# EasyEDA Pro project CV键盘三键键盘四键键盘九键键盘有线小键盘.eprj, board 1x3+6_rgb
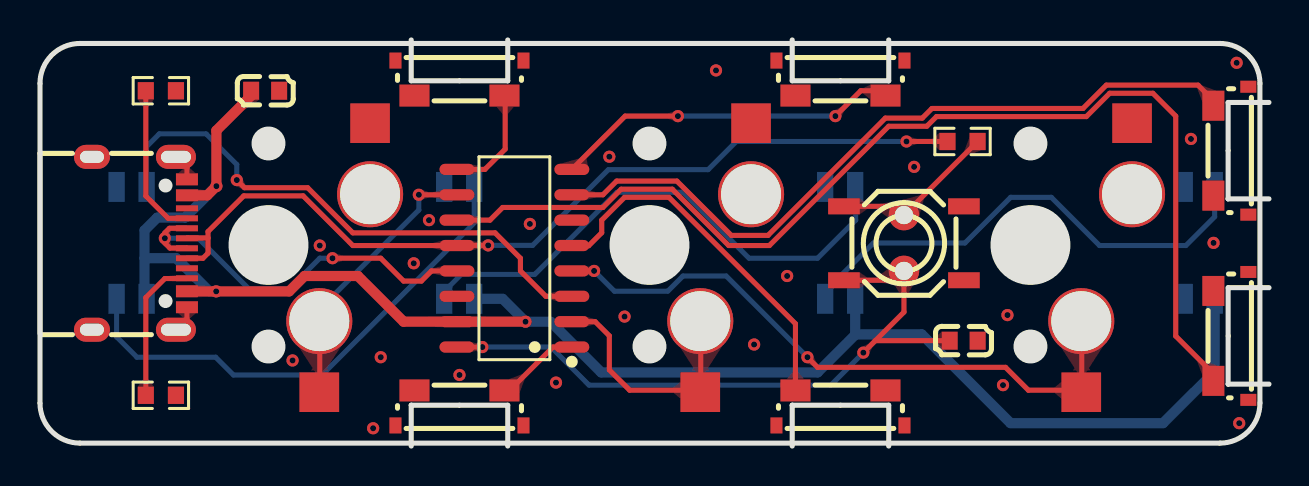
[diagram p13: board, top side]
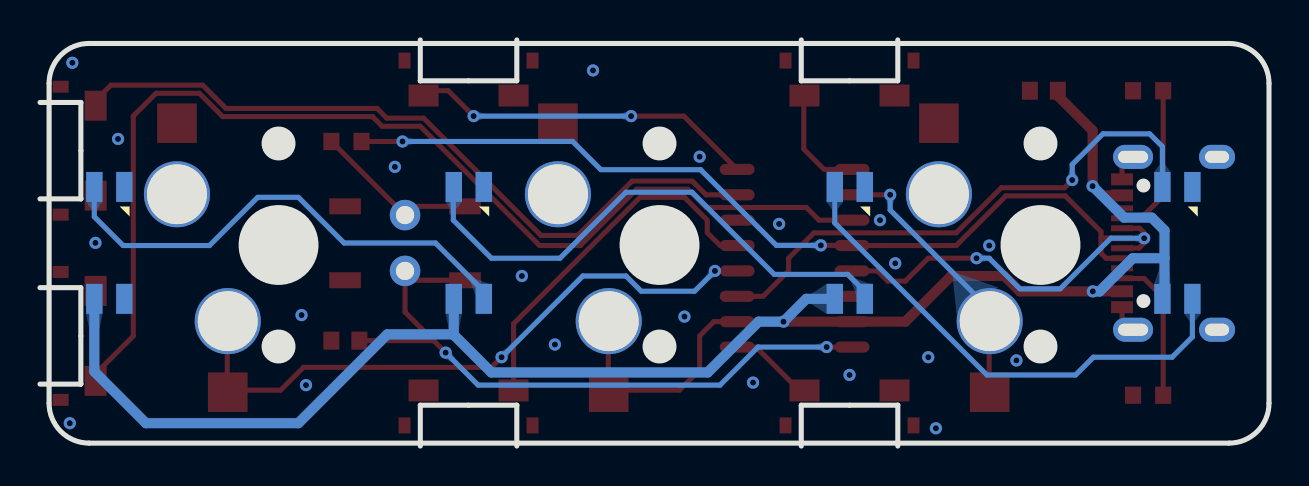
[diagram p14: board, bottom side, seen from below]

Outline 61.45 x 20.32 mm; copper layers: Top Layer, Bottom Layer. Coordinates in mm from the lower left corner of the outline.
Outline path: 0,18.15 arc(0.59,19.56) 2,20.15 59,20.15 arc(60.41,19.56) 61,18.15 61,2.15 arc(60.41,0.73) 59,0.15 2,0.15 arc(0.59,0.73) 0,2.15 0,18.15
Stack: Top Layer 0.035mm / Dielectric1 1.51mm FR4 er 4.5 / Bottom Layer 0.035mm

## Design rules (mm)
spacing Default (default): track to track 0.152, other pairs 0 to 0.152
track width Default (default): min 0.254, default 0.305, max 25.4
differential pair differentialPair (default): width min 0.127, default 0.254, max 2.54; gap min 0.152, default 0.152
via Default (default): diameter min 0.61, default 0.61, max 100.025; hole min 0.305, default 0.305, max 59.995
net GND uses gge1415

## Placement (name value [footprint] x y rotation side)
C1  100nF  [C0603]  46.19 5.27 0 top
C2  100nF  [C0603]  11.26 17.78 180 top
KEY1  -  [热插拔轴座]  49.55 10.16 270 bottom
KEY2  -  [热插拔轴座]  30.5 10.16 270 bottom
KEY3  -  [热插拔轴座]  11.45 10.16 270 bottom
NOREF  -  [Pad_e99]  43.2 11.56 90 top
NOREF#2  -  [Pad_e101]  43.2 8.76 90 top
R1  10K  [R0603]  46.13 15.24 0 top
R2  5.1K  [R0603]  6.05 17.78 0 top
R3  5.1K  [R0603]  6.05 2.54 0 top
SW1  TSA356G00-250  [SW-SMD_TSA356G00-250]  59.55 14.78 90 top
SW1#2  TS-1076S-A1B2  [SW-SMD_4P-L5.2-W5.2-P3.70-LS6.4]  43.2 10.15 180 top
SW2  TSA356G00-250  [SW-SMD_TSA356G00-250]  59.55 5.51 90 top
SW3  TSA356G00-250  [SW-SMD_TSA356G00-250]  40.03 18.41 180 top
SW4  TSA356G00-250  [SW-SMD_TSA356G00-250]  40.03 1.91 0 top
SW5  TSA356G00-250  [SW-SMD_TSA356G00-250]  20.97 18.41 180 top
SW6  TSA356G00-250  [SW-SMD_TSA356G00-250]  20.97 1.91 0 top
U1  CH552G  [SOP-16_L10.0-W3.9-P1.27-LS6.0-BL]  23.72 9.4 90 top
U2  TypeC-16PIN  [USB-C-SMD_TYPE-C-6PIN-2MD-073]  4.97 10.15 270 top
U3  -  [ws2812反贴灯上装不挖槽反捏]  4.59 10.17 90 top
U4  -  [ws2812反贴灯上装不挖槽反捏]  20.97 10.17 90 top
U5  -  [ws2812反贴灯上装不挖槽反捏]  40.03 10.17 90 top
U6  -  [ws2812反贴灯上装不挖槽反捏]  58 10.17 90 top

## Footprints (pads in the part's own frame, mm; a bottom-side part is the same pattern mirrored in y, then rotated)
C0603
  rect 0.8x0.9 smd: 1(-0.7,0) 2(0.7,0)
Pad_e99
  round 1.524 hole 0.914: 1(0,0)
Pad_e101
  round 1.524 hole 0.914: 2(0,0)
R0603
  rect 0.806x0.864 smd: 1(-0.753,0) 2(0.753,0)
SOP-16_L10.0-W3.9-P1.27-LS6.0-BL
  oval 0.56x1.745 smd: 1(-4.445,-2.873) 2(-3.175,-2.873) 3(-1.905,-2.873) 4(-0.635,-2.873) 5(0.635,-2.873) 6(1.905,-2.873) 7(3.175,-2.873) 8(4.445,-2.873) 9(4.445,2.873) 10(3.175,2.873) 11(1.905,2.873) 12(0.635,2.873) 13(-0.635,2.873) 14(-1.905,2.873) 15(-3.175,2.873) 16(-4.445,2.873)
SW-SMD_4P-L5.2-W5.2-P3.70-LS6.4
  rect 1.58x0.8 smd: 1(-2.999,1.849) 2(2.999,1.849) 3(-2.999,-1.849) 4(2.999,-1.849)
SW-SMD_TSA356G00-250
  rect 1.501x1.1 smd: 1(-2.251,0.876) 2(2.251,0.876)
  rect 0.6x0.8 smd: 3(-3.2,-0.874) 4(3.2,-0.874)
USB-C-SMD_TYPE-C-6PIN-2MD-073
  rect 0.6x1.1 smd: 1(-3.2,2.375) 2(-2.4,2.375) 11(2.4,2.375) 12(3.2,2.375)
  rect 0.3x1.1 smd: 3(-1.75,2.375) 4(-1.25,2.375) 5(-0.75,2.375) 6(-0.25,2.375) 7(0.25,2.375) 8(0.75,2.375) 9(1.25,2.375) 10(1.75,2.375)
  oval 1.2x2 hole 0.6x1.5: 13(-4.325,1.825) 14(4.325,1.825)
  oval 1.2x1.8 hole 0.6x1.2: 13(-4.325,-2.375) 14(4.325,-2.375)
ws2812反贴灯上装不挖槽反捏
  rect 1.5x0.82 smd far side: 1(2.794,0.762) 2(2.794,-0.738) 3(-2.806,-0.738) 4(-2.806,0.762)
热插拔轴座
  rect 1.981x1.981 smd far side: 1(-5.995,-5.056) 2(7.466,-2.515)
  round 3.304 hole 3: 1(-2.439,-5.056) 2(3.91,-2.515)

## Nets
As in the schematic, except:
3.3V: C1.1 NOREF#2.2 SW1#2.2 U1.16
RST: NOREF.1 R1.2 SW1#2.4

Pads without a net: SW1#2 1 3; U1 6; U2 3 9; U6 4

## Via types
v1: diameter 0.61, hole 0.305, Top Layer to Bottom Layer, 36 vias

## Routing (per net, layer and track width the routed paths; a pad name or vN(x,y) marks a point on that pad's centre or on a via; arc(x,y) is an arc through that point)
3.3V: length 34.1
  Top Layer w0.254: 41.77,5.27 v1(41.17,4.67) ; 41.77,5.27 43.2,6.7 43.2,8.48 ; 41.77,5.27 C1.1 ; 43.02,8.48 42.92,8.48 42.73,8.3 SW1#2.2 ; 43.02,8.48 43.2,8.48 ; 43.02,8.48 43.02,8.36 ; 43.2,8.48 NOREF#2.2 ; U1.16 v1(22.12,4.95) ; 43.02,8.36 43.02,8.35 42.9,8.23 42.89,8.36 43.02,8.36
  Bottom Layer w0.254: v1(41.17,4.67) 39.54,3.05 27.45,3.05 25.55,4.95 v1(22.12,4.95)
GND: length 2.7
  Top Layer w0.254: U2.12 7.35,6.37 U2.14 ; U2.13 7.35,13.92 U2.1
  vias: v1(12.63,4.28) v1(13.99,10.03) v1(16.66,0.89) v1(17.04,4.44) v1(18.69,9.14) v1(19.45,11.3) v1(20.97,3.56) v1(24.5,11.11) v1(25.8,3.17) v1(28.47,14.48) v1(29.23,6.48) v1(33.8,18.8) v1(35.71,5.08) v1(37.36,8.51) v1(43.71,13.97) v1(48.15,3.05) v1(48.38,6.55) v1(57.55,15.37) v1(58.68,10.17) v1(59.84,19.18) v1(59.96,1.14)
VCC: length 85.3
  Top Layer w0.508: 7.35,7.75 7.36,7.74 v1(8.81,7.74) 12.46,7.74 13.23,8.51 15.9,8.51 18.18,6.22 U1.15 v1(24.28,6.22) ; U2.2 8.36,12.55 v1(8.82,13) 8.82,15.79 10.56,17.53 C2.2
  Bottom Layer w0.508: 40.76,5.56 38.88,3.68 28.06,3.68 25.52,6.22 v1(24.28,6.22) 23.13,7.37 U4.3 ; 40.76,5.56 40.79,5.59 44.09,5.59 48.53,1.14 56.15,1.14 58.74,3.73 58.74,7.37 ; 40.76,5.56 U5.3 ; U3.3 5.23,7.47 5.23,9.4 ; 5.23,9.4 6.81,9.4 8.47,7.74 v1(8.81,7.74) ; 5.23,9.4 5.23,10.8 5.86,11.43 7.25,11.43 v1(8.82,13)
DM: length 19.9
  Top Layer w0.254: U2.7 7.34,9.91 6.5,9.91 6.24,10.16 6.24,10.67 6.47,10.9 U2.5 ; U1.13 19.58,8.76 19.07,8.25 18.18,8.25 17.04,9.4 v1(14.62,9.4)
  Bottom Layer w0.254: v1(6.24,10.4) 7.91,10.4 10.44,7.87 12.46,7.87 13.99,9.4 v1(14.62,9.4)
DP: length 44.2
  Top Layer w0.254: v1(22.41,10.04) 20.86,10.04 U1.12 15.64,10.03 13.15,12.52 10.19,12.52 8.4,10.73 8.4,10.41 ; 8.4,10.41 8.4,9.65 8.15,9.4 U2.8 ; 8.4,10.41 7.37,10.41 U2.6 ; v1(43.33,15.24) R1.1
  Bottom Layer w0.254: v1(43.33,15.24) 34.82,15.24 33.41,13.83 28.42,13.83 24.63,10.04 v1(22.41,10.04)
K1: length 32.2
  Top Layer w0.254: 52.09,2.65 52.09,2.78 ; 52.09,2.78 52.09,6.21 ; 52.09,2.78 52.08,2.79 49.42,2.79 48.28,3.94 38.88,3.94 v1(38.37,4.44) ; v1(27.71,8.76) U1.4
  Bottom Layer w0.254: v1(27.71,8.76) 28.72,7.75 31.39,7.75 32.15,8.51 34.31,8.51 v1(38.37,4.44)
K2: length 12.3
  Top Layer w0.254: U1.2 27.76,6.22 28.47,5.52 28.47,3.81 29.48,2.79 33.04,2.79 33.04,6.22
K3: length 13.8
  Top Layer w0.254: v1(18.94,12.57) U1.10 ; 13.99,2.78 13.99,6.34
  Bottom Layer w0.254: 13.99,6.34 13.99,6.86 18.94,11.81 v1(18.94,12.57)
RGB: length 27.7
  Top Layer w0.254: U1.3 25.29,7.49 24.02,8.76 24.02,9.4 22.75,10.67 15.64,10.67 13.38,12.93 10.22,12.93 v1(9.84,13.31)
  Bottom Layer w0.254: v1(9.84,13.31) 9.84,14.09 8.31,15.62 5.97,15.62 5.33,14.99 U3.2
RST: length 8.4
  Top Layer w0.254: SW1#2.4 42.76,11.99 NOREF.1 R1.2
S1: length 37.2
  Top Layer w0.254: U1.7 28.15,12.57 28.83,13.26 31.85,13.26 34.56,10.54 36.4,10.54 42.27,16.41 44.11,16.41 44.6,16.89 52.15,16.89 53.32,18.06 57.91,18.06 58.67,17.3 SW1.2
S2: length 55.4
  Top Layer w0.254: SW2.1 58.67,3.62 56.79,5.5 56.79,16.51 55.65,17.65 53.49,17.65 52.32,16.48 44.83,16.48 44.34,16 42.44,16 36.47,10.03 34.44,10.03 31.62,12.85 29.06,12.85 28.15,11.94 23.13,11.94 22.5,11.3 U1.11
S3: length 17.3
  Top Layer w0.254: v1(31.9,16.51) 29.26,16.51 U1.8 ; v1(39.77,16.51) 41.04,17.78 42.26,17.78 42.28,17.79
  Bottom Layer w0.254: v1(39.77,16.51) v1(31.9,16.51)
S4: length 18.3
  Top Layer w0.254: 37.77,2.53 37.77,6.12 31.45,12.45 29.23,12.45 28.09,11.3 28.09,10.67 27.44,10.02 27.03,10.02
S5: length 5.8
  Top Layer w0.254: U1.9 22.25,13.84 23.26,14.86 23.26,17.76 23.23,17.79
S6: length 4.4
  Top Layer w0.254: 23.23,2.53 25.65,4.95 U1.1
$1N7262: length 25.5
  Bottom Layer w0.254: U4.2 21.71,11.16 14.1,3.56 9.67,3.56 8.78,4.44 4.85,4.44 3.83,5.46 U3.4
$1N7266: length 26.8
  Bottom Layer w0.254: U5.2 40.79,12.94 40.79,11.3 38.88,9.4 35.45,9.4 32.15,12.7 28.85,12.7 24.74,8.59 21.07,8.59 20.21,7.74 U4.4
$1N7270: length 24.9
  Bottom Layer w0.254: U5.4 39.26,7.75 41.68,10.16 46.25,10.16 48.53,12.45 50.57,12.45 52.98,10.03 57.3,10.03 58.74,11.47 58.74,12.97
$1N10650: length 7.5
  Top Layer w0.254: U2.4 6.4,11.4 5.29,12.51 5.29,17.52
$1N10653: length 7.3
  Top Layer w0.254: 7.35,8.38 6.24,8.38 5.29,7.43 R3.1

## Copper pours and planes (outline as drawn; the poured copper is in the pictures)
GND on Top Layer: 64.51,-1.84 64.76,21.89 -2.66,22.18 -2.84,-1.84
GND on Bottom Layer: 64.43,-0.95 64.57,22.41 -2.73,22.55 -2.9,-0.95

Small or netless copper shapes (teardrops, artwork), in the pictures only: 64 on Top Layer, 24 on Bottom Layer

## Text on the board
Top Layer: 看着碍事拖动一下红色和蓝色框框铺铜就没了 / shift+b重新铺铜
